# Altium schematic sheet schematic1.SchDoc (part 2 of 3)
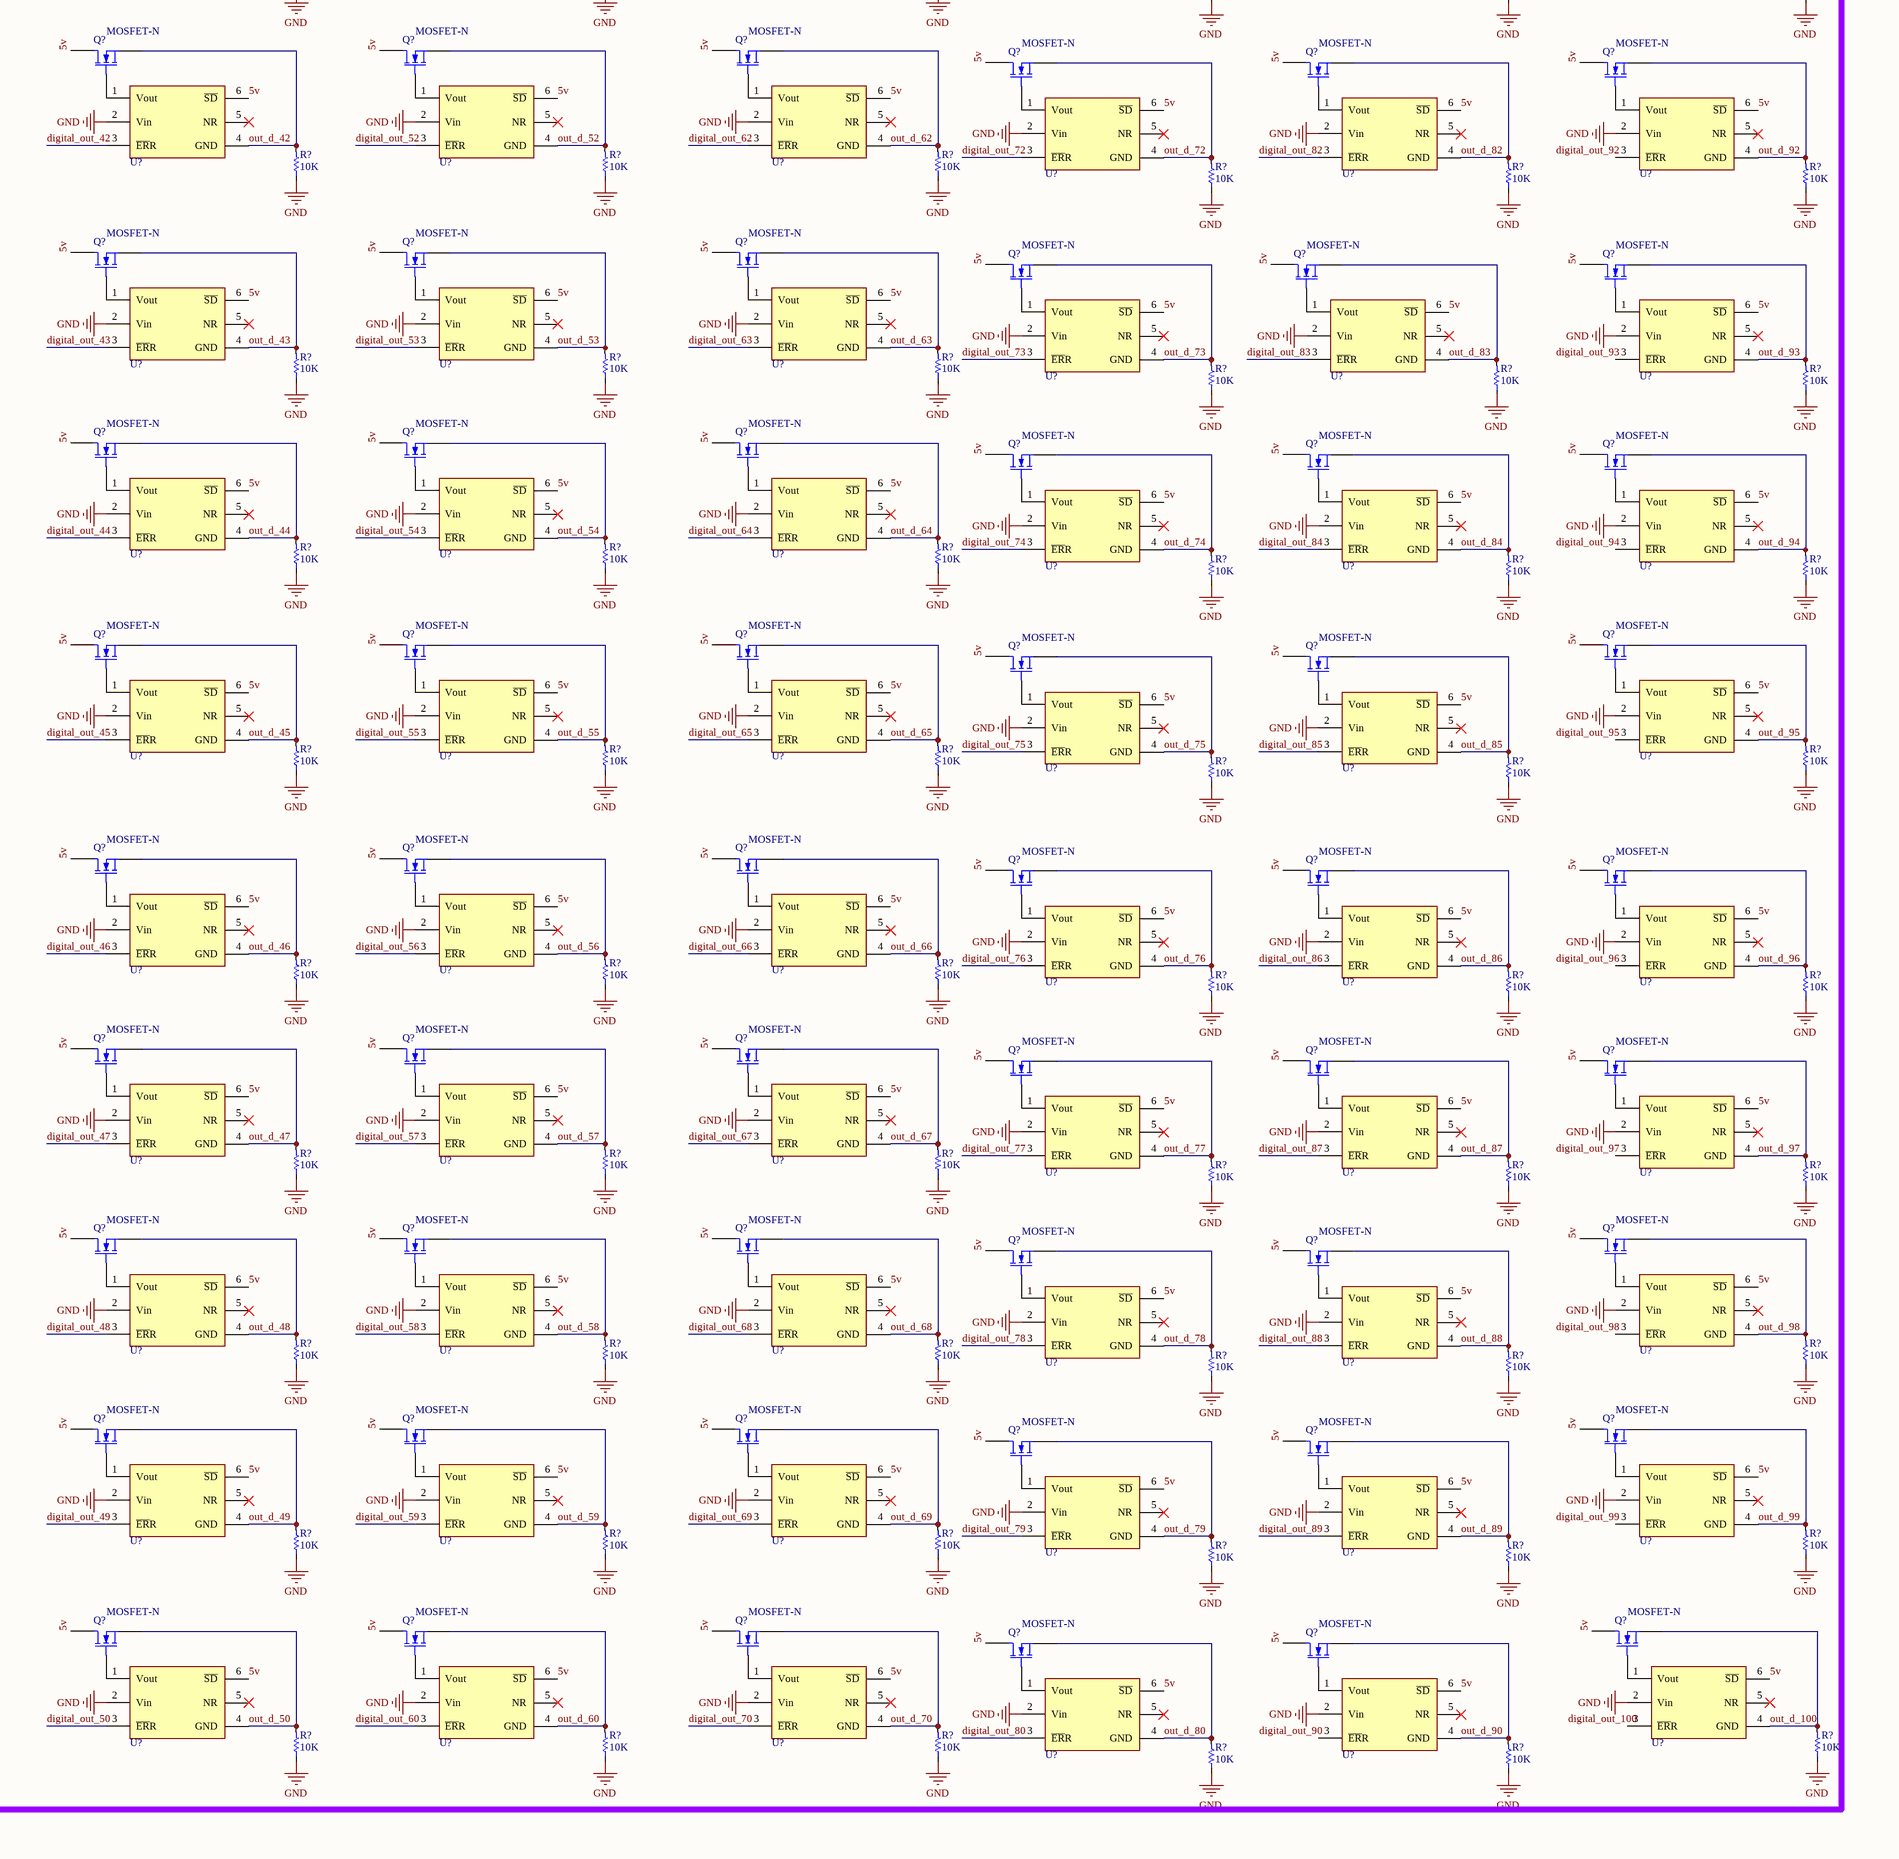
[diagram p8: schematic1.SchDoc, bottom column 4 of 4]
## Nets
1: C?#89.2 C?#90.2 C?#91.2 C?#92.2 C?#93.2 C?#94.2 C?#95.2 C?#105.1 C?#106.1 C?#107.1 C?#108.1 C?#109.2 U?#4.G8(VCCPINT) U?#4.H9(VCCPINT) U?#4.J8(VCCPINT) U?#4.L8(VCCPINT) U?#4.N8(VCCPINT) U?#4.R8(VCCPINT)
1.8: C?#96.2 C?#97.2 C?#98.2 C?#99.2 C?#100.2 C?#101.2 C?#102.1 C?#103.1 C?#104.1 U?#4.K9(VCCPAUX) U?#4.M9(VCCPAUX) U?#4.P9(VCCPAUX) U?#4.T9(VCCPAUX)
1V8: C?#54.2 C?#55.2 C?#56.2 C?#57.2 C?#58.2 C?#59.2 C?#60.2 C?#61.2 C?#62.2 C?#63.2 C?#64.2 C?#65.2 C?#68.1 C?#69.1 C?#70.1 C?#71.1 C?#72.1 C?#73.1 C?#74.1 C?#75.1 C?#76.2 C?#77.2 C?#78.2 C?#80.2 C?#81.2 C?#82.2 C?#83.2 C?#84.2 C?#85.2 C?#86.1 C?#87.1 C?#88.1 C?#111.2 C?#112.2 C?#113.2 C?#114.2 C?#115.2 C?#116.2 C?#117.2 C?#118.2 C?#119.2 C?#120.2 C?#121.2 C?#129.2 C?#130.2 C?#131.1 C?#132.1 C?#133.1 C?#134.1 C?#135.1 C?#136.1 C?#137.1 C?#138.1 C?#139.2 C?#140.2 C?#141.2 C?#142.2 C?#143.2 C?#144.2 C?#145.2 C?#146.2 C?#147.2 C?#148.2 C?#149.1 C?#150.1 C?#159.2 FL?#1.2 R?#132.2 U?#4.A10(VCCO_MIO1_501) U?#4.B13(VCCO_MIO1_501) U?#4.D9(VCCO_MIO1_501) U?#4.E2(VCCO_DDR_502) U?#4.E12(VCCO_MIO1_501) U?#4.F5(VCCO_DDR_502) U?#4.G9(VCCBATT_0) U?#4.H1(VCCO_DDR_502) U?#4.H11(VCCBRAM) U?#4.J4(VCCO_DDR_502) U?#4.J10(VCCBRAM) U?#4.J12(VCCINT) U?#4.J14(VCCINT) U?#4.K7(VCCO_DDR_502) U?#4.K13(VCCINT) U?#4.L10(VCCAUX) U?#4.L14(VCCINT) U?#4.M3(VCCO_DDR_502) U?#4.M13(VCCINT) U?#4.N6(VCCO_DDR_502) U?#4.N10(VCCAUX) U?#4.N14(VCCINT) U?#4.P11(VCCAUX) U?#4.P13(VCCINT) U?#4.R2(VCCO_DDR_502) U?#4.R10(VCCAUX) U?#4.R14(VCCINT) U?#4.V1(VCCO_DDR_502) U?#5.F8(PS_MIO_VREF_501) U?#7.M11(VREFP_0)
3V3: C?#1.1 C?#15.1 C?#16.1 C?#17.1 C?#18.1 C?#19.2 C?#20.2 C?#21.2 C?#22.2 C?#23.2 C?#24.2 C?#25.2 C?#26.2 C?#27.2 C?#41.1 C?#42.1 C?#43.1 C?#44.1 C?#45.2 C?#46.2 C?#47.2 C?#48.2 C?#49.2 C?#50.2 C?#51.2 C?#52.2 C?#53.2 C?#123.1 C?#124.1 C?#125.2 C?#126.2 C?#127.2 C?#128.2 C?#166.2 C?#167.2 J?#2.1 J?#3.1 J?#4.1 J?#5.1 J?#6.02 J?#7.1 R?#141.2 R?#175.2 R?#176.2 R?#199.2 R?#226.2 U?#2.AA10(VCCO_13) U?#2.AA20(VCCO_33) U?#2.AB3(VCCO_13) U?#2.AB13(VCCO_33) U?#2.R12(VCCO_0) U?#2.T5(VCCO_13) U?#2.T7(RSVDVCC1) U?#2.T8(RSVDVCC2) U?#2.T10(RSVDVCC3) U?#2.U8(VCCO_13) U?#2.U18(VCCO_33) U?#2.V11(VCCO_13) U?#2.V21(VCCO_33) U?#2.W4(VCCO_13) U?#2.W14(VCCO_33) U?#2.Y7(VCCO_13) U?#2.Y17(VCCO_33) U?#4.B3(VCCO_MIO0_500) U?#4.C6(VCCO_MIO0_500) U?#8.8(VCC) Y?#4.4(VDD)
AVDD33: C1.1 C2.1 C?#1.2 C?#2.1 C?#3.1 C?#4.1 C?#5.1 C?#6.1 C?#7.1 C?#8.1 C?#9.1 C?#10.1 C?#11.2 C?#12.2 C?#13.2 C?#14.2 C?#15.2 C?#16.2 C?#17.2 C?#18.2 C?#19.1 C?#20.1 C?#21.1 C?#22.1 C?#23.1 C?#24.1 C?#25.1 C?#26.1 C?#27.1 C?#28.1 C?#29.1 C?#30.1 C?#31.1 C?#32.1 C?#33.1 C?#34.1 C?#35.1 C?#36.1 C?#37.2 C?#38.2 C?#39.2 C?#40.2 C?#41.2 C?#42.2 C?#43.2 C?#44.2 C?#45.1 C?#46.1 C?#47.1 C?#48.1 C?#49.1 C?#50.1 C?#51.1 C?#52.1 C?#53.1 C?#54.1 C?#55.1 C?#56.1 C?#57.1 C?#58.1 C?#59.1 C?#60.1 C?#61.1 C?#62.1 C?#63.1 C?#64.1 C?#65.1 C?#66.1 C?#67.1 C?#68.2 C?#69.2 C?#70.2 C?#71.2 C?#72.2 C?#73.2 C?#74.2 C?#75.2 C?#76.1 C?#77.1 C?#78.1 C?#79.1 C?#80.1 C?#81.1 C?#82.1 C?#83.1 C?#84.1 C?#85.1 C?#86.2 C?#87.2 C?#88.2 C?#96.1 C?#97.1 C?#98.1 C?#99.1 C?#100.1 C?#101.1 C?#102.2 C?#103.2 C?#104.2 C?#105.2 C?#106.2 C?#107.2 C?#108.2 C?#109.1 C?#110.1 C?#111.1 C?#112.1 C?#113.1 C?#114.1 C?#115.1 C?#116.1 C?#117.1 C?#118.1 C?#119.1 C?#120.1 C?#121.1 C?#122.1 C?#123.2 C?#124.2 C?#125.1 C?#126.1 C?#127.1 C?#128.1 C?#129.1 C?#130.1 C?#131.2 C?#132.2 C?#133.2 C?#134.2 C?#135.2 C?#136.2 C?#137.2 C?#138.2 C?#139.1 C?#140.1 C?#141.1 C?#142.1 C?#143.1 C?#144.1 C?#151.1 C?#152.1 C?#153.1 C?#154.1 C?#155.1 C?#156.1 C?#157.1 C?#158.1 C?#160.1 C?#161.2 C?#162.1 C?#163.1 C?#164.1 C?#165.1 C?#166.1 C?#167.1 C?#169.1 C?#170.1 C?#171.1 C?#172.1 C?#173.1 C?#174.1 C?#175.1 C?#176.1 C?#177.1 C?#178.1 C?#179.1 C?#180.1 C?#181.1 C?#182.1 C?#183.1 C?#184.1 C?#185.1 C?#186.1 C?#187.1 C?#188.1 C?#189.1 C?#190.1 C?#191.1 C?#195.1 C?#199.1 C?#200.1 C?#201.1 C?#202.1 C?#203.1 C?#204.1 C?#205.1 C?#206.1 C?#207.1 C?#210.1 C?#211.1 C?#212.1 C?#213.1 C?#214.1 C?#215.1 C?#216.1 C?#217.1 C?#219.1 C?#220.1 C?#221.1 C?#222.1 C?#223.1 C?#224.1 C?#225.1 C?#226.1 C?#227.1 C?#231.1 C?#235.1 D?#1.A D?#2.A D?#3.A D?#4.A D?#5.C FL?#3.1 J1.5 J1.10(MH1) J1.11(MH2) J2.5 J2.10(MH1) J2.11(MH2) J?#1.10(GND) J?#1.11(YA) J?#1.13(GA) J?#2.3 J?#3.3 J?#4.3 J?#5.3 J?#6.01 J?#6.03 J?#6.05 J?#6.07 J?#6.09 J?#6.11 J?#6.13 J?#7.3 J?#8.16 J?#9.5 J?#9.10(MH1) J?#9.11(MH2) J?#10.5 J?#10.10(MH1) J?#10.11(MH2) J?#11.5 J?#11.10(MH1) J?#11.11(MH2) J?#12.5 J?#12.10(MH1) J?#12.11(MH2) J?#13.5 J?#13.10(MH1) J?#13.11(MH2) J?#14.5 J?#14.10(MH1) J?#14.11(MH2) J?#15.5 J?#15.10(MH1) J?#15.11(MH2) J?#16.5 J?#16.10(MH1) J?#16.11(MH2) R?#3.2 R?#4.2 R?#7.2 R?#10.2 R?#11.2 R?#12.2 R?#14.2 R?#15.2 R?#16.2 R?#19.2 R?#20.2 R?#23.2 R?#24.2 R?#25.2 R?#28.2 R?#29.2 R?#32.2 R?#34.2 R?#37.2 R?#38.2 R?#41.2 R?#42.2 R?#45.2 R?#48.2 R?#49.2 R?#52.2 R?#53.2 R?#56.2 R?#57.2 R?#58.2 R?#63.2 R?#64.2 R?#65.2 R?#66.2 R?#71.2 R?#72.2 R?#73.2 R?#74.2 R?#79.2 R?#80.2 R?#81.2 R?#82.2 R?#86.2 R?#87.2 R?#88.2 R?#92.2 R?#93.2 R?#96.2 R?#97.2 R?#99.2 R?#101.1 R?#103.2 R?#104.1 R?#106.2 R?#107.2 R?#110.2 R?#113.2 R?#115.2 R?#116.2 R?#120.2 R?#121.2 R?#125.2 R?#126.2 R?#129.2 R?#130.2 R?#133.2 R?#134.2 R?#136.2 R?#138.2 R?#139.2 R?#146.2 R?#147.2 R?#149.2 R?#151.2 R?#152.2 R?#154.2 R?#155.2 R?#158.2 R?#161.2 R?#168.2 R?#170.2 R?#177.1 R?#179.2 R?#182.2 R?#183.2 R?#186.2 R?#187.2 R?#190.2 R?#191.2 R?#194.2 R?#195.2 R?#200.2 R?#201.2 R?#204.2 R?#205.2 R?#207.2 R?#209.1 R?#210.1 R?#212.2 R?#213.2 R?#216.2 R?#220.2 R?#222.2 R?#224.2 R?#227.2 R?#229.2 R?#231.2 R?#239.1 R?#240.1 R?#241.1 R?#242.1 R?#243.1 R?#244.1 R?#245.1 R?#246.1 R?#247.1 R?#248.1 R?#252.1 R?#253.1 R?#254.1 R?#255.1 R?#256.1 R?#257.1 R?#258.1 R?#259.1 R?#260.1 R?#261.1 R?#264.1 R?#265.1 R?#266.1 R?#267.1 R?#268.1 R?#269.1 R?#270.1 R?#271.1 R?#272.1 R?#273.1 R?#274.1 R?#275.1 R?#276.1 R?#277.1 R?#278.1 R?#280.1 R?#281.1 R?#282.1 R?#283.1 R?#284.1 R?#290.1 R?#291.1 R?#292.1 R?#293.1 R?#294.1 R?#295.1 R?#296.1 R?#297.1 R?#298.1 R?#299.1 R?#310.1 R?#311.1 R?#312.1 R?#313.1 R?#314.1 R?#315.1 R?#316.1 R?#317.1 R?#318.1 R?#319.1 R?#320.1 R?#321.1 R?#322.1 R?#323.1 R?#324.1 R?#325.1 R?#326.1 R?#327.1 R?#328.1 R?#329.1 R?#332.1 R?#333.1 R?#334.1 R?#335.1 R?#336.1 R?#337.1 R?#338.1 R?#339.1 R?#340.1 R?#341.1 R?#344.1 R?#345.1 R?#346.1 R?#347.1 R?#348.1 R?#349.1 R?#350.1 R?#351.1 R?#352.1 R?#353.1 R?#354.1 R?#355.1 R?#356.1 R?#357.1 R?#358.1 R?#359.1 R?#360.1 R?#361.1 R?#362.1 R?#363.1 S1.1 S?#1.1 S?#2.3 S?#2.4 S?#3.1 S?#4.3 S?#4.4 U1.10(VSS_5) U1.19(VSSA) U1.27(VSS_4) U1.49(VSS_1) U1.74(VSS_2) U1.99(VSS_3) U2.10(VSS_5) U2.19(VSSA) U2.27(VSS_4) U2.49(VSS_1) U2.74(VSS_2) U2.99(VSS_3) U3.10(VSS_5) U3.19(VSSA) U3.27(VSS_4) U3.49(VSS_1) U3.74(VSS_2) U3.99(VSS_3) U4.A9(DACGND_2) U4.B5(DACGND) U4.M5(ADCGND) U5.A9(DACGND_2) U5.B5(DACGND) U5.M5(ADCGND) U6.A9(DACGND_2) U6.B5(DACGND) U6.M5(ADCGND) U7.A9(DACGND_2) U7.B5(DACGND) U7.M5(ADCGND) U8.A9(DACGND_2) U8.B5(DACGND) U8.M5(ADCGND) U9.A9(DACGND_2) U9.B5(DACGND) U9.M5(ADCGND) U10.A9(DACGND_2) U10.B5(DACGND) U10.M5(ADCGND) U11.15(GND) U12.15(GND) U13.15(GND) U14.15(GND) U15.15(GND) U?#3.A5(GND) U?#3.A15(GND) U?#3.AA5(GND) U?#3.AA15(GND) U?#3.AB8(GND) U?#3.AB18(GND) U?#3.B8(GND) U?#3.B18(GND) U?#3.C1(GND) U?#3.C11(GND) U?#3.C21(GND) U?#3.D4(GND) U?#3.D14(GND) U?#3.E7(GND) U?#3.E17(GND) U?#3.F10(GND) U?#3.F20(GND) U?#3.G3(GND) U?#3.H6(GND) U?#3.H8(GND) U?#3.H12(GND) U?#3.H14(GND) U?#3.H16(GND) U?#3.J9(GND) U?#3.J11(GND) U?#3.J13(GND) U?#3.J19(GND) U?#3.K2(GND) U?#3.K8(GND) U?#3.K10(GND) U?#3.K14(GND) U?#3.K22(GND) U?#3.L5(GND) U?#3.L9(GND) U?#3.L13(GND) U?#3.L15(GND) U?#3.M8(GND) U?#3.M10(GND) U?#3.M14(GND) U?#3.M18(GND) U?#3.N1(GND) U?#3.N9(GND) U?#3.N13(GND) U?#3.N21(GND) U?#3.P4(GND) U?#3.P8(GND) U?#3.P10(GND) U?#3.P12(GND) U?#3.P14(GND) U?#3.R9(GND) U?#3.R11(GND) U?#3.R13(GND) U?#3.R17(GND) U?#3.T20(GND) U?#3.U3(GND) U?#3.U13(GND) U?#3.V6(GND) U?#3.V16(GND) U?#3.W9(GND) U?#3.W19(GND) U?#3.Y2(GND) U?#3.Y12(GND) U?#3.Y22(GND) U?#6.3(DVDD) U?#6.7(VDDO-2) U?#6.11(CONFIG) U?#6.16(AVDD33-1) U?#6.21(AVDD33) U?#6.36(DVDD-1) U?#6.43(VDDO-1) U?#6.46(VDDO) U?#8.4(VSS) U?#8.9(EP) U?#9.2(Vin) U?#9.3(~{ER}R) U?#10.2(Vin) U?#10.3(~{ER}R) U?#11.2(Vin) U?#11.3(~{ER}R) U?#12.2(Vin) U?#12.3(~{ER}R) U?#13.2(Vin) U?#13.3(~{ER}R) U?#14.2(Vin) U?#15.2(Vin) U?#16.2(Vin) U?#17.2(Vin) U?#18.2(Vin) U?#19.2(Vin) U?#20.2(Vin) U?#21.2(Vin) U?#22.2(Vin) U?#23.2(Vin) U?#24.2(Vin) U?#24.3(~{ER}R) U?#25.2(Vin) U?#25.3(~{ER}R) U?#26.2(Vin) U?#26.3(~{ER}R) U?#27.2(Vin) U?#27.3(~{ER}R) U?#28.2(Vin) U?#28.3(~{ER}R) U?#29.2(Vin) U?#29.3(~{ER}R) U?#30.2(Vin) U?#30.3(~{ER}R) U?#31.2(Vin) U?#31.3(~{ER}R) U?#32.2(Vin) U?#32.3(~{ER}R) U?#33.2(Vin) U?#33.3(~{ER}R) U?#34.2(Vin) U?#35.2(Vin) U?#36.2(Vin) U?#37.2(Vin) U?#38.2(Vin) U?#39.2(Vin) U?#40.2(Vin) U?#41.2(Vin) U?#42.2(Vin) U?#43.2(Vin) U?#44.2(Vin) U?#44.3(~{ER}R) U?#45.2(Vin) U?#45.3(~{ER}R) U?#46.2(Vin) U?#46.3(~{ER}R) U?#47.2(Vin) U?#47.3(~{ER}R) U?#48.2(Vin) U?#48.3(~{ER}R) U?#49.2(Vin) U?#49.3(~{ER}R) U?#50.2(Vin) U?#50.3(~{ER}R) U?#51.2(Vin) U?#51.3(~{ER}R) U?#52.2(Vin) U?#52.3(~{ER}R) U?#53.2(Vin) U?#53.3(~{ER}R) U?#54.2(Vin) U?#55.2(Vin) U?#56.2(Vin) U?#56.3(~{ER}R) U?#57.2(Vin) U?#57.3(~{ER}R) U?#58.2(Vin) U?#58.3(~{ER}R) U?#59.2(Vin) U?#59.3(~{ER}R) U?#60.2(Vin) U?#60.3(~{ER}R) U?#61.2(Vin) U?#62.2(Vin) U?#63.2(Vin) U?#64.2(Vin) U?#65.2(Vin) U?#66.2(Vin) U?#67.2(Vin) U?#68.2(Vin) U?#69.2(Vin) U?#69.3(~{ER}R) U?#70.2(Vin) U?#70.3(~{ER}R) U?#71.2(Vin) U?#71.3(~{ER}R) U?#72.2(Vin) U?#72.3(~{ER}R) U?#73.2(Vin) U?#73.3(~{ER}R) U?#74.2(Vin) U?#74.3(~{ER}R) U?#75.2(Vin) U?#75.3(~{ER}R) U?#76.2(Vin) U?#76.3(~{ER}R) U?#77.2(Vin) U?#77.3(~{ER}R) U?#78.2(Vin) U?#78.3(~{ER}R) U?#79.2(Vin) U?#80.2(Vin) U?#81.2(Vin) U?#82.2(Vin) U?#83.2(Vin) U?#84.2(Vin) U?#85.2(Vin) U?#86.2(Vin) U?#87.2(Vin) U?#88.2(Vin) U?#89.2(Vin) U?#89.3(~{ER}R) U?#90.2(Vin) U?#90.3(~{ER}R) U?#91.2(Vin) U?#91.3(~{ER}R) U?#92.2(Vin) U?#92.3(~{ER}R) U?#93.2(Vin) U?#93.3(~{ER}R) U?#94.2(Vin) U?#94.3(~{ER}R) U?#95.2(Vin) U?#95.3(~{ER}R) U?#96.2(Vin) U?#96.3(~{ER}R) U?#97.2(Vin) U?#97.3(~{ER}R) U?#98.2(Vin) U?#98.3(~{ER}R) U?#99.2(Vin) U?#100.2(Vin) U?#101.2(Vin) U?#102.2(Vin) U?#103.2(Vin) U?#104.2(Vin) U?#105.2(Vin) U?#106.2(Vin) U?#107.2(Vin) U?#108.2(Vin) U?#109.2(Vin) U?#109.3(~{ER}R) U?#110.2(Vin) U?#110.3(~{ER}R) U?#111.2(Vin) U?#111.3(~{ER}R) U?#112.2(Vin) U?#112.3(~{ER}R) U?#113.2(Vin) U?#113.3(~{ER}R) U?#114.2(Vin) U?#114.3(~{ER}R) U?#115.2(Vin) U?#115.3(~{ER}R) U?#116.2(Vin) U?#116.3(~{ER}R) U?#117.2(Vin) U?#117.3(~{ER}R) U?#118.2(Vin) U?#118.3(~{ER}R) U?#119.2(Vin) U?#120.2(Vin) U?#121.2(Vin) U?#122.2(Vin) U?#123.2(Vin) U?#124.2(Vin) U?#125.2(Vin) U?#126.2(Vin) U?#127.2(Vin) U?#128.2(Vin) U?#129.2(Vin) U?#129.3(~{ER}R) U?#130.2(Vin) U?#130.3(~{ER}R) U?#131.2(Vin) U?#131.3(~{ER}R) U?#132.2(Vin) U?#132.3(~{ER}R) U?#133.2(Vin) U?#133.3(~{ER}R) U?#134.2(Vin) U?#134.3(~{ER}R) U?#135.2(Vin) U?#135.3(~{ER}R) U?#136.2(Vin) U?#136.3(~{ER}R) U?#137.2(Vin) U?#137.3(~{ER}R) U?#138.2(Vin) U?#138.3(~{ER}R) U?#139.2(Vin) U?#140.2(Vin) U?#141.2(Vin) U?#142.2(Vin) U?#143.2(Vin) U?#144.2(Vin) U?#145.2(Vin) U?#146.2(Vin) U?#147.2(Vin) U?#148.2(Vin) U?#149.2(Vin) U?#149.3(~{ER}R) U?#150.2(Vin) U?#150.3(~{ER}R) U?#151.2(Vin) U?#151.3(~{ER}R) U?#152.2(Vin) U?#152.3(~{ER}R) U?#153.2(Vin) U?#153.3(~{ER}R) U?#154.2(Vin) U?#154.3(~{ER}R) U?#155.2(Vin) U?#155.3(~{ER}R) U?#156.2(Vin) U?#156.3(~{ER}R) U?#157.2(Vin) U?#157.3(~{ER}R) U?#158.2(Vin) U?#158.3(~{ER}R) U?#159.2(Vin) U?#160.2(Vin) U?#161.2(Vin) U?#162.2(Vin) U?#163.2(Vin) U?#164.2(Vin) U?#165.2(Vin) U?#166.2(Vin) U?#167.2(Vin) U?#168.2(Vin) U?#169.2(Vin) U?#169.3(~{ER}R) U?#170.2(Vin) U?#171.2(Vin) U?#171.3(~{ER}R) U?#172.2(Vin) U?#172.3(~{ER}R) U?#173.2(Vin) U?#173.3(~{ER}R) U?#174.2(Vin) U?#174.3(~{ER}R) U?#175.2(Vin) U?#176.2(Vin) U?#176.3(~{ER}R) U?#177.2(Vin) U?#177.3(~{ER}R) U?#178.2(Vin) U?#178.3(~{ER}R) U?#179.2(Vin) U?#180.2(Vin) U?#181.2(Vin) U?#182.2(Vin) U?#183.2(Vin) U?#184.2(Vin) U?#185.2(Vin) U?#186.2(Vin) U?#187.2(Vin) U?#188.2(Vin) U?#189.2(Vin) U?#189.3(~{ER}R) U?#190.2(Vin) U?#191.2(Vin) U?#191.3(~{ER}R) U?#192.2(Vin) U?#192.3(~{ER}R) U?#193.2(Vin) U?#193.3(~{ER}R) U?#194.2(Vin) U?#194.3(~{ER}R) U?#195.2(Vin) U?#196.2(Vin) U?#196.3(~{ER}R) U?#197.2(Vin) U?#197.3(~{ER}R) U?#198.2(Vin) U?#198.3(~{ER}R) U?#199.2(Vin) U?#200.2(Vin) U?#201.2(Vin) U?#202.2(Vin) U?#203.2(Vin) U?#204.2(Vin) U?#205.2(Vin) U?#206.2(Vin) U?#207.2(Vin) U?#208.2(Vin) Y?#4.2(GND)  [also labelled DVDD, GND, VCC3V3, VDD]
VADJ: C?#2.2 C?#3.2 C?#4.2 C?#5.2 C?#6.2 C?#7.2 C?#8.2 C?#9.2 C?#10.2 C?#11.1 C?#12.1 C?#13.1 C?#14.1 C?#28.2 C?#29.2 C?#30.2 C?#31.2 C?#32.2 C?#33.2 C?#34.2 C?#35.2 C?#36.2 C?#37.1 C?#38.1 C?#39.1 C?#40.1 J?#8.15 U?#2.A20(VCCO_35) U?#2.C16(VCCO_35) U?#2.D19(VCCO_35) U?#2.E22(VCCO_35) U?#2.F15(VCCO_35) U?#2.G18(VCCO_35) U?#2.H21(VCCO_35) U?#2.K17(VCCO_34) U?#2.L20(VCCO_34) U?#2.N16(VCCO_34) U?#2.P19(VCCO_34) U?#2.R22(VCCO_34) U?#2.T15(VCCO_34)
3.3v: C?#192.2 C?#196.2 C?#208.2 C?#228.2 C?#232.2 U1.11(VDD_5) U1.22(VDDA) U1.28(VDD_4) U1.50(VDD_1) U1.75(VDD_2) U1.100(VDD_3) U2.11(VDD_5) U2.22(VDDA) U2.28(VDD_4) U2.50(VDD_1) U2.75(VDD_2) U2.100(VDD_3) U3.11(VDD_5) U3.22(VDDA) U3.28(VDD_4) U3.50(VDD_1) U3.75(VDD_2) U3.100(VDD_3) U11.16(VCC) U12.16(VCC) U13.16(VCC) U14.16(VCC) U15.16(VCC) U?#9.6(~{SD}) U?#10.6(~{SD}) U?#11.6(~{SD}) U?#12.6(~{SD}) U?#13.6(~{SD}) U?#24.6(~{SD}) U?#25.6(~{SD}) U?#26.6(~{SD}) U?#27.6(~{SD}) U?#28.6(~{SD}) U?#29.6(~{SD}) U?#30.6(~{SD}) U?#31.6(~{SD}) U?#32.6(~{SD}) U?#33.6(~{SD}) U?#44.6(~{SD}) U?#45.6(~{SD}) U?#46.6(~{SD}) U?#47.6(~{SD}) U?#48.6(~{SD}) U?#49.6(~{SD}) U?#50.6(~{SD}) U?#51.6(~{SD}) U?#52.6(~{SD}) U?#53.6(~{SD}) U?#56.6(~{SD}) U?#57.6(~{SD}) U?#58.6(~{SD}) U?#59.6(~{SD}) U?#60.6(~{SD}) U?#69.6(~{SD}) U?#70.6(~{SD}) U?#71.6(~{SD}) U?#72.6(~{SD}) U?#73.6(~{SD}) U?#74.6(~{SD}) U?#75.6(~{SD}) U?#76.6(~{SD}) U?#77.6(~{SD}) U?#78.6(~{SD}) U?#89.6(~{SD}) U?#90.6(~{SD}) U?#91.6(~{SD}) U?#92.6(~{SD}) U?#93.6(~{SD}) U?#94.6(~{SD}) U?#95.6(~{SD}) U?#96.6(~{SD}) U?#97.6(~{SD}) U?#98.6(~{SD}) U?#109.6(~{SD}) U?#110.6(~{SD}) U?#111.6(~{SD}) U?#112.6(~{SD}) U?#113.6(~{SD}) U?#114.6(~{SD}) U?#115.6(~{SD}) U?#116.6(~{SD}) U?#117.6(~{SD}) U?#118.6(~{SD}) U?#129.6(~{SD}) U?#130.6(~{SD}) U?#131.6(~{SD}) U?#132.6(~{SD}) U?#133.6(~{SD}) U?#134.6(~{SD}) U?#135.6(~{SD}) U?#136.6(~{SD}) U?#137.6(~{SD}) U?#138.6(~{SD}) U?#149.6(~{SD}) U?#150.6(~{SD}) U?#151.6(~{SD}) U?#152.6(~{SD}) U?#153.6(~{SD}) U?#154.6(~{SD}) U?#155.6(~{SD}) U?#156.6(~{SD}) U?#157.6(~{SD}) U?#158.6(~{SD}) U?#169.6(~{SD}) U?#170.6(~{SD}) U?#171.6(~{SD}) U?#172.6(~{SD}) U?#173.6(~{SD}) U?#174.6(~{SD}) U?#175.6(~{SD}) U?#176.6(~{SD}) U?#177.6(~{SD}) U?#178.6(~{SD}) U?#189.6(~{SD}) U?#190.6(~{SD}) U?#191.6(~{SD}) U?#192.6(~{SD}) U?#193.6(~{SD}) U?#194.6(~{SD}) U?#195.6(~{SD}) U?#196.6(~{SD}) U?#197.6(~{SD}) U?#198.6(~{SD})
5v: C?#174.2 C?#175.2 C?#176.2 C?#177.2 C?#178.2 C?#179.2 C?#180.2 C?#181.2 C?#182.2 C?#183.2 C?#184.2 C?#185.2 C?#186.2 C?#187.2 C?#188.2 C?#189.2 C?#190.2 C?#191.2 C?#200.2 C?#201.2 C?#202.2 C?#203.2 C?#204.2 C?#205.2 C?#206.2 C?#207.2 C?#210.2 C?#211.2 C?#212.2 C?#213.2 C?#214.2 C?#215.2 C?#216.2 C?#217.2 C?#219.2 C?#220.2 C?#221.2 C?#222.2 C?#223.2 C?#224.2 C?#225.2 C?#226.2 Q?#1.1(D) Q?#2.1(D) Q?#3.1(D) Q?#4.1(D) Q?#5.1(D) Q?#6.1(D) Q?#7.1(D) Q?#8.1(D) Q?#9.1(D) Q?#10.1(D) Q?#11.1(D) Q?#12.1(D) Q?#13.1(D) Q?#14.1(D) Q?#15.1(D) Q?#16.1(D) Q?#17.1(D) Q?#18.1(D) Q?#19.1(D) Q?#20.1(D) Q?#21.1(D) Q?#22.1(D) Q?#23.1(D) Q?#24.1(D) Q?#25.1(D) Q?#26.1(D) Q?#27.1(D) Q?#28.1(D) Q?#29.1(D) Q?#30.1(D) Q?#31.1(D) Q?#32.1(D) Q?#33.1(D) Q?#34.1(D) Q?#35.1(D) Q?#36.1(D) Q?#37.1(D) Q?#38.1(D) Q?#39.1(D) Q?#40.1(D) Q?#41.1(D) Q?#42.1(D) Q?#43.1(D) Q?#44.1(D) Q?#45.1(D) Q?#46.1(D) Q?#47.1(D) Q?#48.1(D) Q?#49.1(D) Q?#50.1(D) Q?#51.1(D) Q?#52.1(D) Q?#53.1(D) Q?#54.1(D) Q?#55.1(D) Q?#56.1(D) Q?#57.1(D) Q?#58.1(D) Q?#59.1(D) Q?#60.1(D) Q?#61.1(D) Q?#62.1(D) Q?#63.1(D) Q?#64.1(D) Q?#65.1(D) Q?#66.1(D) Q?#67.1(D) Q?#68.1(D) Q?#69.1(D) Q?#70.1(D) Q?#71.1(D) Q?#72.1(D) Q?#73.1(D) Q?#74.1(D) Q?#75.1(D) Q?#76.1(D) Q?#77.1(D) Q?#78.1(D) Q?#79.1(D) Q?#80.1(D) Q?#81.1(D) Q?#82.1(D) Q?#83.1(D) Q?#84.1(D) Q?#85.1(D) Q?#86.1(D) Q?#87.1(D) Q?#88.1(D) Q?#89.1(D) Q?#90.1(D) Q?#91.1(D) Q?#92.1(D) Q?#93.1(D) Q?#94.1(D) Q?#95.1(D) Q?#96.1(D) Q?#97.1(D) Q?#98.1(D) Q?#99.1(D) Q?#100.1(D) R?#233.1 R?#234.1 R?#235.1 R?#236.1 R?#237.1 R?#238.1 R?#249.1 R?#250.1 R?#251.1 R?#286.1 R?#287.1 R?#288.1 R?#289.1 R?#300.1 R?#301.1 R?#302.1 R?#303.1 R?#304.1 R?#305.1 R?#306.1 R?#307.1 U?#14.6(~{SD}) U?#15.6(~{SD}) U?#16.6(~{SD}) U?#17.6(~{SD}) U?#18.6(~{SD}) U?#19.6(~{SD}) U?#20.6(~{SD}) U?#21.6(~{SD}) U?#22.6(~{SD}) U?#23.6(~{SD}) U?#34.6(~{SD}) U?#35.6(~{SD}) U?#36.6(~{SD}) U?#37.6(~{SD}) U?#38.6(~{SD}) U?#39.6(~{SD}) U?#40.6(~{SD}) U?#41.6(~{SD}) U?#42.6(~{SD}) U?#43.6(~{SD}) U?#54.6(~{SD}) U?#55.6(~{SD}) U?#61.6(~{SD}) U?#62.6(~{SD}) U?#63.6(~{SD}) U?#64.6(~{SD}) U?#65.6(~{SD}) U?#66.6(~{SD}) U?#67.6(~{SD}) U?#68.6(~{SD}) U?#79.6(~{SD}) U?#80.6(~{SD}) U?#81.6(~{SD}) U?#82.6(~{SD}) U?#83.6(~{SD}) U?#84.6(~{SD}) U?#85.6(~{SD}) U?#86.6(~{SD}) U?#87.6(~{SD}) U?#88.6(~{SD}) U?#99.6(~{SD}) U?#100.6(~{SD}) U?#101.6(~{SD}) U?#102.6(~{SD}) U?#103.6(~{SD}) U?#104.6(~{SD}) U?#105.6(~{SD}) U?#106.6(~{SD}) U?#107.6(~{SD}) U?#108.6(~{SD}) U?#119.6(~{SD}) U?#120.6(~{SD}) U?#121.6(~{SD}) U?#122.6(~{SD}) U?#123.6(~{SD}) U?#124.6(~{SD}) U?#125.6(~{SD}) U?#126.6(~{SD}) U?#127.6(~{SD}) U?#128.6(~{SD}) U?#139.6(~{SD}) U?#140.6(~{SD}) U?#141.6(~{SD}) U?#142.6(~{SD}) U?#143.6(~{SD}) U?#144.6(~{SD}) U?#145.6(~{SD}) U?#146.6(~{SD}) U?#147.6(~{SD}) U?#148.6(~{SD}) U?#159.6(~{SD}) U?#160.6(~{SD}) U?#161.6(~{SD}) U?#162.6(~{SD}) U?#163.6(~{SD}) U?#164.6(~{SD}) U?#165.6(~{SD}) U?#166.6(~{SD}) U?#167.6(~{SD}) U?#168.6(~{SD}) U?#179.6(~{SD}) U?#180.6(~{SD}) U?#181.6(~{SD}) U?#182.6(~{SD}) U?#183.6(~{SD}) U?#184.6(~{SD}) U?#185.6(~{SD}) U?#186.6(~{SD}) U?#187.6(~{SD}) U?#188.6(~{SD}) U?#199.6(~{SD}) U?#200.6(~{SD}) U?#201.6(~{SD}) U?#202.6(~{SD}) U?#203.6(~{SD}) U?#204.6(~{SD}) U?#205.6(~{SD}) U?#206.6(~{SD}) U?#207.6(~{SD}) U?#208.6(~{SD})
adc_clk_1: bank_13.AA12(IO_L7P_T1_13) U4.L7(ASCLK)
adc_clk_2: bank_13.AB10(IO_L9P_T1_DQS_13) U5.L7(ASCLK)
adc_clk_3: bank_13.AA9(IO_L11P_T1_SRCC_13) U6.L7(ASCLK)
adc_clk_4: bank_13.Y6(IO_L13P_T2_MRCC_13) U7.L7(ASCLK)
adc_clk_5: bank_13.AB2(IO_L15P_T2_DQS_13) U8.L7(ASCLK)
adc_clk_6: bank_13.AB7(IO_L17P_T2_13) U9.L7(ASCLK)
adc_clk_7: bank_13.R6(IO_L19P_T3_13) U10.L7(ASCLK)
adc_output_1: bank_13.AA11(IO_L8P_T1_13) U4.M6(ADOUT)
adc_output_2: bank_13.Y11(IO_L10P_T1_13) U5.M6(ADOUT)
adc_output_3: bank_13.Y9(IO_L12P_T1_MRCC_13) U6.M6(ADOUT)
adc_output_4: bank_13.AA7(IO_L14P_T2_SRCC_13) U7.M6(ADOUT)
adc_output_5: bank_13.AB5(IO_L16P_T2_13) U8.M6(ADOUT)
adc_output_6: bank_13.Y4(IO_L18P_T2_13) U9.M6(ADOUT)
adc_output_7: bank_13.T4(IO_L20P_T3_13) U10.M6(ADOUT)
analog_out_1: U4.A1(VOUT0) U?#9.1(Vout)
analog_out_2: U4.B9(VOUT1) U?#24.1(Vout)
analog_out_3: U4.C2(VOUT2) U?#29.1(Vout)
analog_out_4: U4.B4(VOUT3) U?#48.1(Vout)
analog_out_5: U4.D2(VOUT4) U?#51.1(Vout)
analog_out_6: U4.A3(VOUT5) U?#56.1(Vout)
analog_out_7: U4.E2(VOUT6) U?#69.1(Vout)
analog_out_8: U4.A2(VOUT7) U?#74.1(Vout)
analog_out_9: U4.A10(VOUT8) U?#89.1(Vout)
analog_out_10: U4.C11(VOUT9) U?#95.1(Vout)
analog_out_11: U4.A11(VOUT10) U?#109.1(Vout)
analog_out_12: U4.D11(VOUT11) U?#114.1(Vout)
analog_out_13: U4.B10(VOUT12) U?#129.1(Vout)
analog_out_14: U4.E11(VOUT13) U?#134.1(Vout)
analog_out_15: U4.A12(VOUT14) U?#149.1(Vout)
analog_out_16: U4.F11(VOUT15) U?#154.1(Vout)
analog_out_17: U5.A1(VOUT0) U?#169.1(Vout)
analog_out_18: U5.B9(VOUT1) U?#174.1(Vout)
analog_out_19: U5.C2(VOUT2) U?#189.1(Vout)
analog_out_20: U5.B4(VOUT3) U?#194.1(Vout)
analog_out_21: U5.D2(VOUT4)
analog_out_22: U5.A3(VOUT5) U?#25.1(Vout)
analog_out_23: U5.E2(VOUT6) U?#30.1(Vout)
analog_out_24: U5.A2(VOUT7) U?#44.1(Vout)
analog_out_25: U5.A10(VOUT8) U?#52.1(Vout)
analog_out_26: U5.C11(VOUT9) U?#57.1(Vout)
analog_out_27: U5.A11(VOUT10) U?#70.1(Vout)
analog_out_28: U5.D11(VOUT11) U?#75.1(Vout)
analog_out_29: U5.B10(VOUT12) U?#90.1(Vout)
analog_out_30: U5.E11(VOUT13)
analog_out_31: U5.A12(VOUT14) U?#110.1(Vout)
analog_out_32: U5.F11(VOUT15) U?#115.1(Vout)
analog_out_33: U6.A1(VOUT0) U?#130.1(Vout)
analog_out_34: U6.B9(VOUT1) U?#135.1(Vout)
analog_out_35: U2.77(PA15/JTDI) U6.C2(VOUT2) U?#150.1(Vout)
analog_out_36: U2.78(PC10(USART4_TX)) U6.B4(VOUT3) U?#155.1(Vout)
analog_out_37: U2.79(PC11(USART4_RX)) U6.D2(VOUT4) U?#170.1(Vout)
analog_out_38: U2.80(PC12(SDIO_CLK)) U6.A3(VOUT5) U?#175.1(Vout)
analog_out_39: U2.81(PD0) U6.E2(VOUT6) U?#190.1(Vout)
analog_out_40: U2.82(PD1) U6.A2(VOUT7) U?#195.1(Vout)
analog_out_41: U2.83(PD2(SDIO_CMD)) U6.A10(VOUT8) U?#11.1(Vout)
analog_out_42: U2.84(PD3) U6.C11(VOUT9) U?#26.1(Vout)
analog_out_43: U2.85(PD4) U6.A11(VOUT10) U?#31.1(Vout)
analog_out_44: U2.86(PD5(USART2_TX)) U6.D11(VOUT11) U?#45.1(Vout)
analog_out_45: U2.87(PD6(USART2_RX)) U6.B10(VOUT12) U?#53.1(Vout)
analog_out_46: U2.88(PD7) U6.E11(VOUT13) U?#58.1(Vout)
analog_out_47: U2.89(PB3/JTDO) U6.A12(VOUT14) U?#71.1(Vout)
analog_out_48: U2.90(PB4/JNTRST) U6.F11(VOUT15) U?#76.1(Vout)
analog_out_49: U2.91(PB5) U7.A1(VOUT0) U?#91.1(Vout)
analog_out_50: U2.92(PB6(I2C1_SCL)) U7.B9(VOUT1) U?#97.1(Vout)
analog_out_51: U2.93(PB7(I2C1_SDA)) U7.C2(VOUT2) U?#111.1(Vout)
analog_out_52: U2.95(PB8) U7.B4(VOUT3) U?#116.1(Vout)
analog_out_53: U2.96(PB9) U7.D2(VOUT4) U?#131.1(Vout)
analog_out_54: U2.97(PE0) U7.A3(VOUT5) U?#136.1(Vout)
analog_out_55: U2.98(PE1) U7.E2(VOUT6) U?#151.1(Vout)
analog_out_56: U2.1(PE2) U7.A2(VOUT7) U?#156.1(Vout)
analog_out_57: U2.2(PE3) U7.A10(VOUT8) U?#171.1(Vout)
analog_out_58: U2.3(PE4) U7.C11(VOUT9) U?#176.1(Vout)
analog_out_59: U2.4(PE5) U7.A11(VOUT10) U?#191.1(Vout)
analog_out_60: U2.5(PE6) U7.D11(VOUT11) U?#196.1(Vout)
analog_out_61: U2.7(PC13-TAMPER-RTC) U7.B10(VOUT12) U?#12.1(Vout)
analog_out_62: U2.8(PC14-OSC32_IN) U7.E11(VOUT13) U?#27.1(Vout)
analog_out_63: U2.9(PC15-OSC32_OUT) U7.A12(VOUT14) U?#32.1(Vout)
analog_out_64: U2.15(PC0(ADC123_IN10)) U7.F11(VOUT15) U?#46.1(Vout)
analog_out_65: U2.16(PC1(ADC123_IN11)) U8.A1(VOUT0) U?#49.1(Vout)
analog_out_66: U2.17(PC2(ADC123_IN12)) U8.B9(VOUT1) U?#59.1(Vout)
analog_out_67: U2.18(PC3(ADC123_IN13)) U8.C2(VOUT2) U?#72.1(Vout)